# EasyEDA Pro project Athena.eprj, board PCB (continued)
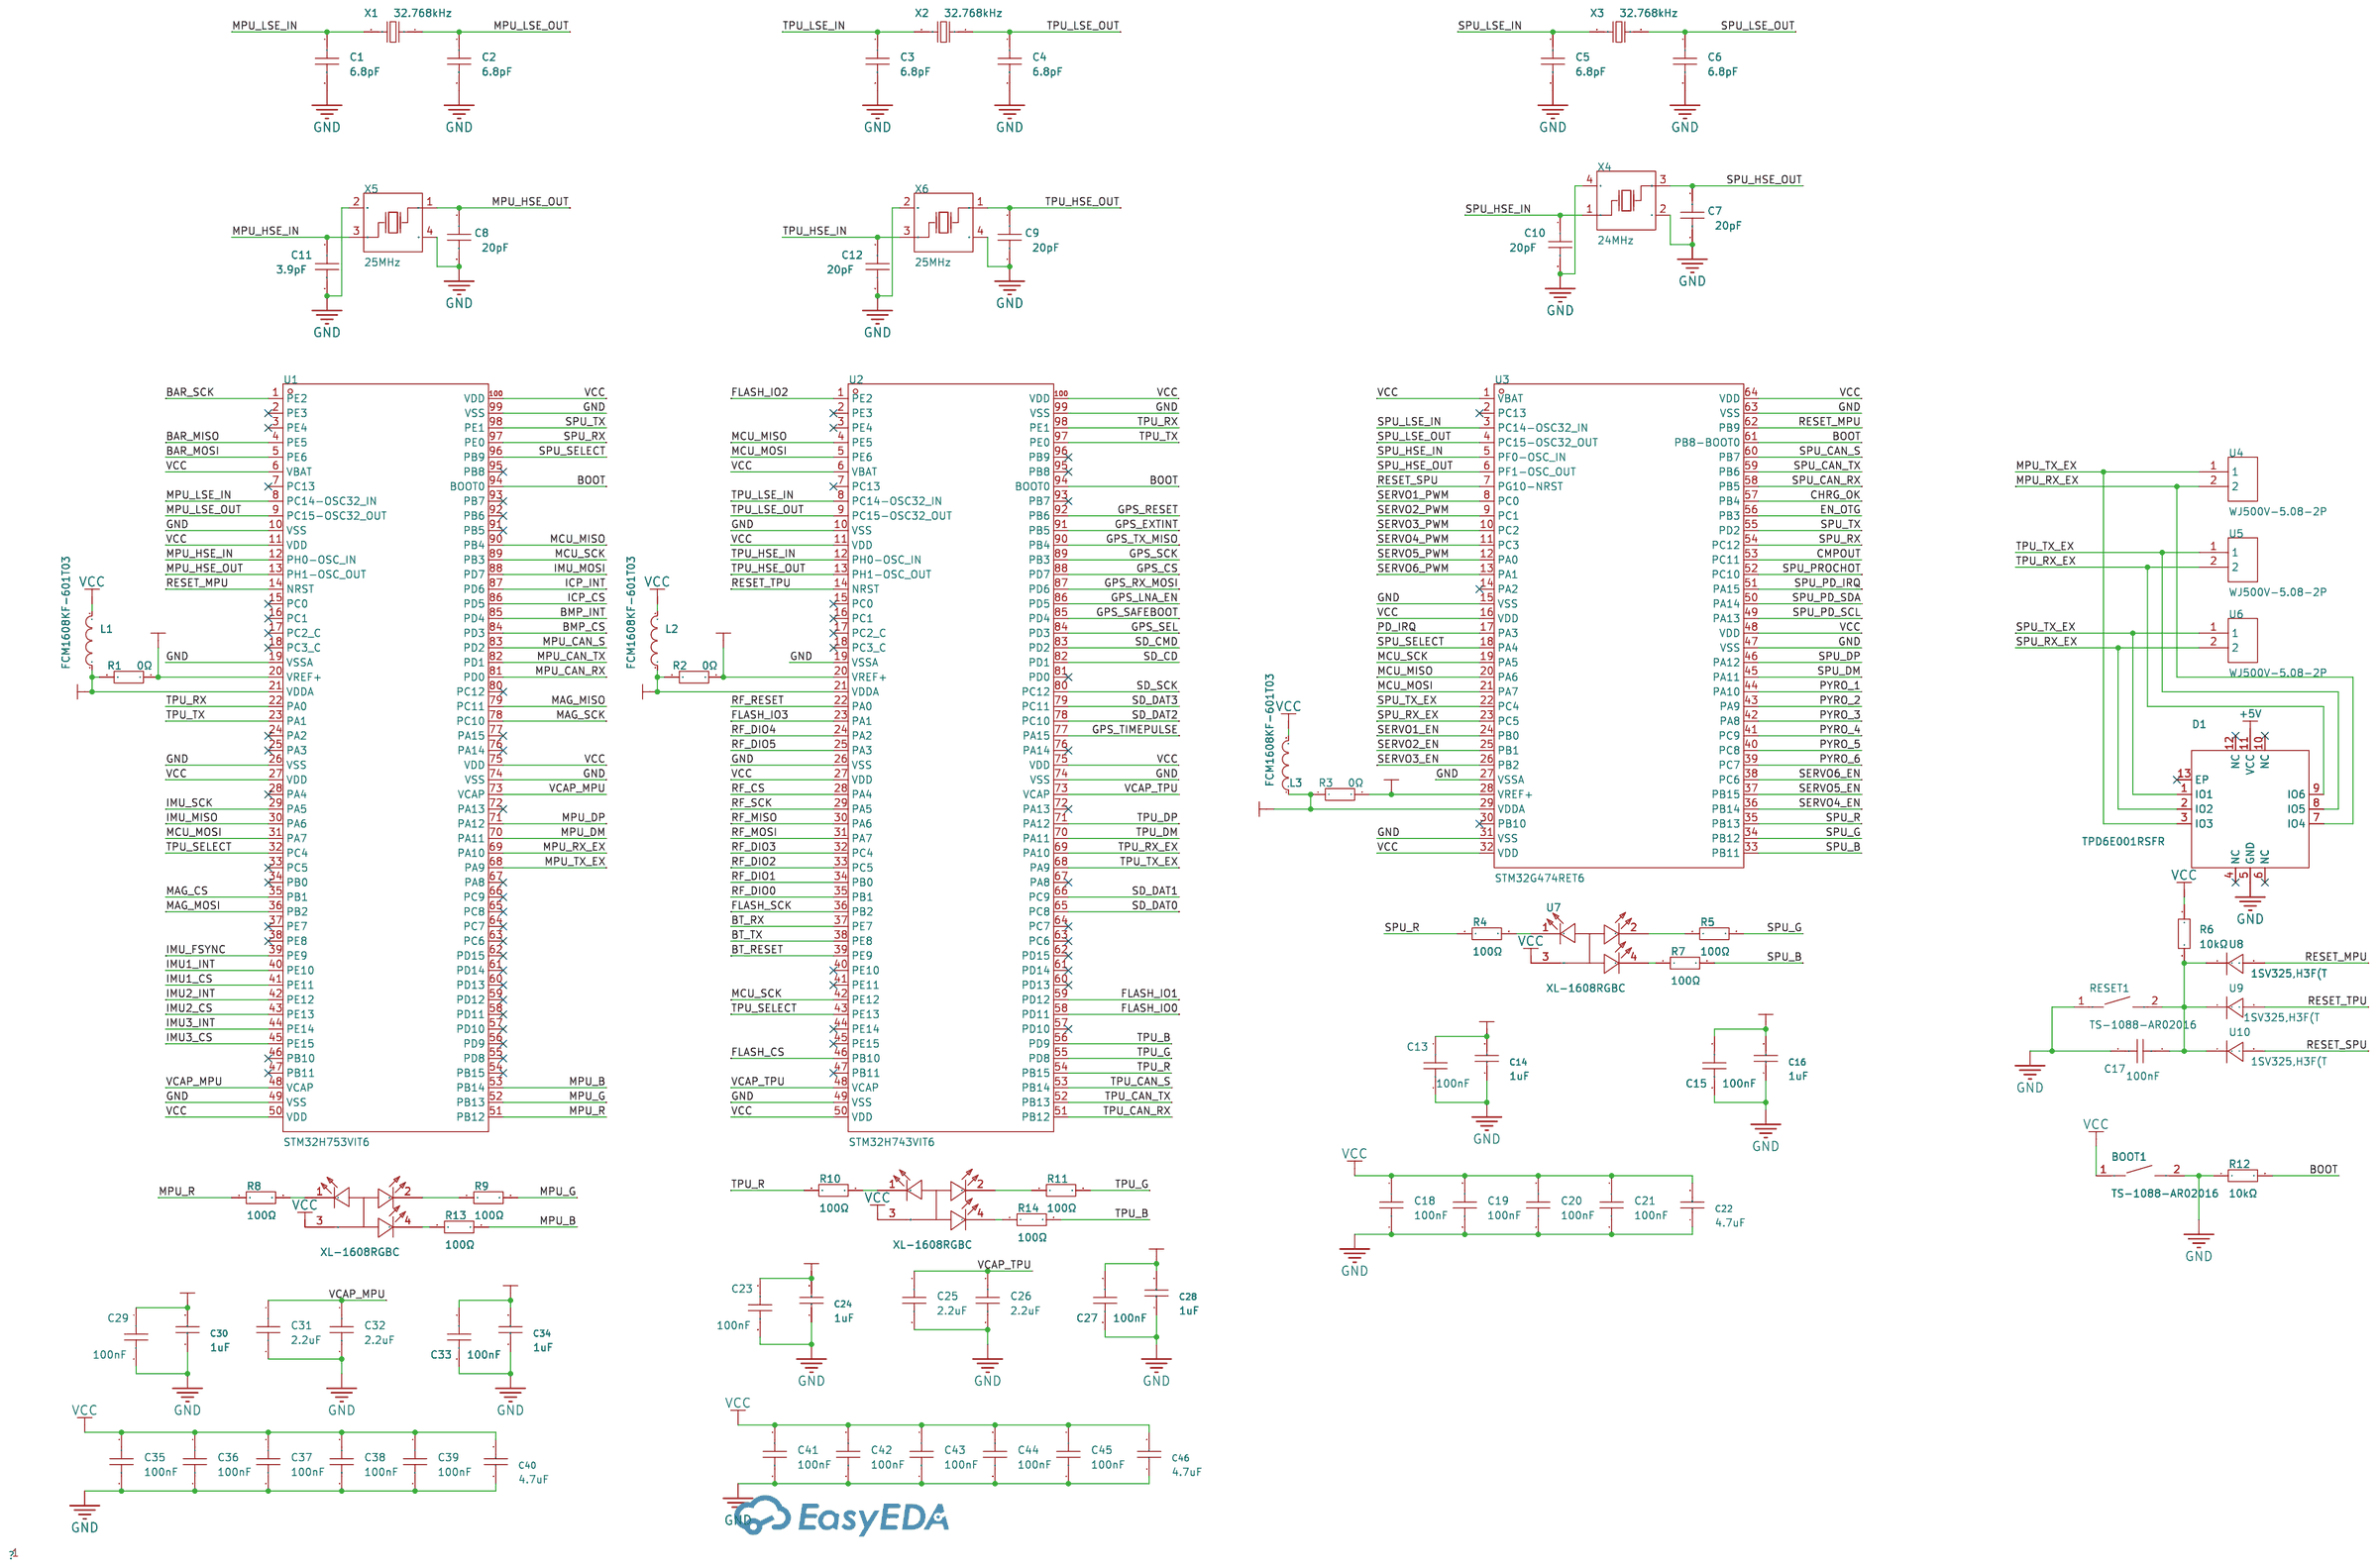
[diagram p0: Processors]
## Routing (per net, layer and track width the routed paths; a pad name or vN(x,y) marks a point on that pad's centre or on a via; arc(x,y) is an arc through that point) (continued)
$3N12479: length 8.2
  Top Layer w0.2: PYRO3.2 68.37,37.4 v1(67.7,37.4)
  Bottom Layer w0.2: 72.47,39.61 71.46,38.6 68.9,38.6 v1(67.7,37.4)
  Bottom Layer w0.4: P3.1 74.16,39.61 72.47,39.61
$3N12483: length 3
  Bottom Layer w0.4: P3.2 75.61,35.86 F3.1
$3N12487: length 1.6
  Bottom Layer w0.4: Q20.1 70.65,39.7 70.65,41.21
$3N13186: length 2.5
  Top Layer w0.2: v1(68.9,61) 68.37,61 PYRO4.1
  Bottom Layer w0.2: v1(68.9,61) 69.11,60.79 R81.2
$3N13188: length 2.9
  Bottom Layer w0.4: R69.2 R81.1 71.56,62.25 71.53,62.29
$3N13191: length 6.8
  Top Layer w0.2: PYRO4.2 68.35,62.1 v1(68.9,62.1)
  Bottom Layer w0.2: 72.48,64.29 71.49,63.3 70.1,63.3 v1(68.9,62.1)
  Bottom Layer w0.4: P4.1 74.19,64.29 72.48,64.29
$3N13195: length 3
  Bottom Layer w0.4: F4.1 75.43,60.44 P4.2
$3N13199: length 1.6
  Bottom Layer w0.4: R75.2 70.59,64.3 70.58,64.29
$3N13207: length 2.4
  Top Layer w0.2: PYRO5.1 68.31,72.2 v1(68.9,72.2)
  Bottom Layer w0.2: v1(68.9,72.2) 70.22,72.2 R82.2
$3N13209: length 2.9
  Bottom Layer w0.4: R70.2 71.49,70.52 71.49,73.36
$3N13212: length 6.7
  Top Layer w0.2: PYRO5.2 68.3,73.3 v1(68.9,73.3)
  Bottom Layer w0.2: v1(68.9,73.3) 69.93,74.33 71.22,74.33 72.24,75.36 72.44,75.36
  Bottom Layer w0.4: P5.1 74.14,75.36 72.44,75.36
$3N13216: length 3
  Bottom Layer w0.4: F5.1 75.49,71.63 P5.2
$3N13220: length 1.6
  Bottom Layer w0.4: R76.2 70.56,75.37 70.54,75.36
$3N13228: length 2.6
  Top Layer w0.2: v1(68.8,83.2) 68.23,83.2 PYRO6.1
  Bottom Layer w0.2: R83.2 70.43,83.2 v1(68.8,83.2)
$3N13230: length 2.7
  Bottom Layer w0.4: 71.5,84.3 71.5,83.03 R83.1 R71.2
$3N13233: length 7
  Top Layer w0.2: v1(68.8,84.3) 68.2,84.3 PYRO6.2
  Bottom Layer w0.2: v1(68.8,84.3) 70,85.5 71.48,85.5 72.5,86.51
  Bottom Layer w0.4: 72.5,86.51 74.19,86.51 P6.1
$3N13237: length 2.5
  Bottom Layer w0.4: 74.22,83.92 P6.2
$3N13241: length 1.7
  Bottom Layer w0.4: R77.2 70.61,86.56 Q23.1
$3N23254: length 2.8
  Top Layer w0.2: 7.84,49.49 6.62,49.49 C124.1 6.34,49.46 R105.2
$3N39600: length 5.6
  Top Layer w0.4: S1.2 24.1,5.5 24.1,7.34 24.9,8.14 Q12.3
$3N39720: length 5.8
  Top Layer w0.4: Q13.3 28.2,8.49 29.36,7.34 29.36,5.5 S2.2
$3N39836: length 5.6
  Top Layer w0.4: Q14.3 31.5,8.05 32.21,7.34 32.21,5.5 S3.2
$3N39952: length 5.5
  Top Layer w0.4: S4.2 47.46,5.5 47.46,7.34 48.2,8.08 Q15.3
$3N40068: length 5.7
  Top Layer w0.4: S5.2 52.72,5.5 52.72,7.34 51.52,8.54 51.52,8.98 Q16.3
$3N40184: length 5.5
  Top Layer w0.4: S6.2 55.57,5.5 55.57,7.34 54.8,8.11 Q17.3
$4N1461: length 1.4
  Bottom Layer w0.2: C137.1 41.2,82.45 U28.5

## Copper pours and planes (outline as drawn; the poured copper is in the pictures)
+5V on Top Layer: 47.4,37 47.4,39.1 47.7,39.4 53.3,39.4 53.9,38.8 53.9,36.96 47.44,36.96
+5V on Top Layer: 11.3,17.4 11.3,11.86 12.74,10.42 31.82,10.42 32.4,11 32.4,15.8 27.22,20.99 20.85,20.99 17.38,17.51 11.41,17.51
+5V on Bottom Layer: 55.74,37.46 55.84,37.36 55.84,36.9 59.1,36.9 59.3,36.7 59.9,36.7 60,36.8 60,37.4 59.3,37.4 58.84,37.86 57.94,37.86 57.8,38 55.74,38
+5V on POWER: 17.28,17.53 20.95,21.2 34.8,21.2 35.4,21.8 35.4,33.9 40.2,38.7 57.05,38.7 57.89,37.86 58,37.86 58,36.9 45.1,36.9 39.7,31.5 39.7,12.8 37.2,10.3 12.7,10.3 11.2,11.8 11.2,17.53
+5V on POWER: 17.6,12.2 21.65,12.2 21.65,4.45 17.6,4.45
AGND on Bottom Layer: 4.8,27.2 7.8,27.2 10.9,30.3 10.9,46 7.55,49.35 7.55,51.5 8.05,52 21.35,52 21.4,52.05 21.4,53.95 19.6,55.75 5.75,55.75 3.6,53.6 3.6,47.65 7.95,43.3 7.95,32.1 6.75,30.9 4.35,30.9 3.85,30.4 3.85,28.15
AGND on Bottom Layer: 45.4,55.3 69.61,55.3 69.61,51.57 45.4,51.57
AGND on Bottom Layer: 42.42,55.08 42.7,54.8 42.7,52.9 45.4,52.9 45.4,60.2 30.2,60.2 26.9,56.9 18,56.9 16.6,55.5 8,55.5 8,52.29 8.24,52.06 23.36,52.06 23.5,52.2 23.5,54 21.08,54 21.08,55.08
GND on Top Layer: 0,140 80,140 80,0 0,0
GND on Bottom Layer: 0,140 80,140 80,0 0,0
GND on GND: 0,140 80,140 80,0 0,0
GND on SIGNAL: 0,140 80,140 80,0 0,0
GND on GND2: 0,140 80,140 80,0 0,0
VBUS on Top Layer: 61.03,31.23 61.5,31.7 61.5,32.4 61.4,32.5 59.1,32.5 57.8,31.2 57.8,29.1 58,28.9 60.8,28.9 61,29.1 61,31.23
VBUS on Bottom Layer: 53.59,35.9 53.59,33.7 46.8,33.7 46.8,35.9
VBUS on Bottom Layer: 61.5,33.6 60.2,33.6 59.8,33.2 59.8,32.31 59.44,31.96 60.2,31.2 61,31.2 61.5,31.7
VBUS on Bottom Layer: 60.1,35.4 60.1,36.66 56.66,36.66 56.3,36.3 56.3,35.6 56.1,35.4
VBUS on POWER: 42.9,4.47 42.9,31 45.6,33.7 57.7,33.7 60.2,31.2 61,31.2 61.5,31.7 61.5,34.9 59.7,36.7 45.2,36.7 39.9,31.4 39.9,12.6 37.1,9.8 37.1,4.47
VCC on Bottom Layer: 17.8,58.7 22.3,58.7 24.6,61 24.6,64.94 22.6,66.94 20.8,66.94 20.59,66.73 20.59,63.43 19.66,62.5 19.66,60.77 18.85,59.95 17.8,59.95 17.2,59.35 17.8,58.75
VCC on POWER: 0,140 80,140 80,0 0,0
BAT on Bottom Layer: 4.2,21.9 10.55,21.9 19,30.35 19,35.35 20.75,37.1 20.75,38.7 20.55,38.9 18.25,38.9 18.2,38.85 18.2,39.57 17.97,39.8 14.6,39.8 14.1,39.3 14.1,33.5 15.15,32.45 15.15,30 10.85,25.7 4.7,25.7 3.85,24.85 3.85,22.25
PPHV on Top Layer: 61.1,31.1 61.1,27.9 61.3,27.7 66,27.7 66.5,28.2 66.5,30.8 66.1,31.2 61.2,31.2
PPHV on Bottom Layer: 68.9,47.73 68.9,48.1 69.75,48.95 69.75,50.95 69.2,51.5 52.22,51.5 51.6,50.88 51.6,49.5 52.3,48.8 53.8,48.8 54.51,49.51 55.39,49.51 55.9,49 55.9,48.2 56.35,47.75 56.35,47.73
PPHV on Bottom Layer: 61.51,33.6 61.51,32.79 61.6,32.7 61.6,31.6 61.1,31.1 61.1,29.8 65.7,29.8 66,30.1 66,30.9 65.8,31.1 62.8,31.1 62.8,33.6
PPHV on POWER: 61.3,29.8 61.3,31.1 64.9,31.1 65.1,31.3 65.1,47.6 65,47.7 56.2,47.7 55.7,48.2 55.7,50.71 56.14,51.15 69.25,51.15 69.6,50.8 69.6,48.4 68.9,47.7 68.9,30.6 68.1,29.8
VSYS on Top Layer: 11.39,32.6 19.6,32.6 19.95,32.25 19.95,30.55 19.5,30.1 11.5,30.1 11.2,30.4 11.2,32.38
VSYS on Bottom Layer: 16.25,55.95 16.25,59.4 16.15,59.5 9.45,59.5 8.1,58.15 8.1,56.1 8.25,55.95
VSYS on Bottom Layer: 8,51.9 22.3,51.9 24,50.2 27.3,50.2 27.3,44.1 25.6,42.4 22,42.4 21.2,43.2 21.2,48.7 8.83,48.7 8,49.53
VSYS on Bottom Layer: 21.31,49.99 21.5,49.8 21.5,49 21.3,48.8 13.9,48.8 13.9,33.4 14.8,32.5 14.8,30 11.1,30 11.1,46 10.4,46.7 10.4,47 9.19,48.22 9.19,49.99
VSYS on POWER: 8.05,51.75 8.14,51.66 8.14,49.49 8.82,48.8 21.15,48.8 21.4,49.05 21.4,58.1 21.05,58.45 8.1,58.45 8.1,51.8
$2N9095 on Bottom Layer: 40.2,49.8 40.2,46.9 40.8,46.3 45.6,46.3 46.7,47.4 50.9,47.4 51.3,47.8 51.3,51.2 51,51.5 44.9,51.5 43.2,49.8
$2N10669 on Bottom Layer: 33.8,54.9 42.4,54.9 42.4,50 33.8,50
$2N10669 on Bottom Layer: 39.55,51.05 38.9,50.4 37.5,50.4 37.5,47.7 34.5,44.7 34.5,44 34.6,43.9 36.79,43.9 37.59,44.7 39.9,44.7 39.9,49.7 40.4,50.2
$2N10868 on Bottom Layer: 27.63,52.21 27.63,43.87 27.9,43.6 29.7,43.6 30.2,43.1 31.6,43.1 31.6,43.3 31.4,43.5 30.4,43.5 29.7,44.2 29.7,46.52 32.06,48.88 32.06,52.78 28.19,52.78
$2N10868 on Bottom Layer: 23.7,54.9 23.7,50.62 24.21,50.1 26.3,50.1 26.3,51.6 26.82,52.12 32.99,52.12 33.19,52.32 33.19,54.71 33,54.9
$2N11948 on Bottom Layer: 24.9,40 24.6,39.7 22.2,39.7 21.9,40 20.8,40 20.8,39.2 20.5,38.9 18.49,38.9 18.28,39.11 18.28,39.72 17.9,40.1 15.99,40.1 15.34,40.75 15.34,42.34 15.5,42.5 18.7,42.5 18.9,42.3 24.9,42.3
$2N34654 on Top Layer: 20.2,30.13 20.2,38.63 20.57,39 20.57,39 22.9,39 23.1,38.8 23.1,31.06 22.16,30.11 20.21,30.11
$2N35129 on Top Layer: 23.09,25.9 23.09,30.69 23.4,31 23.4,34.96 24.27,34.96 24.99,36.3 29.65,36.3 30.22,35.74 30.22,27.22 28.9,25.9
$3N11988 on POWER: 63.19,3.9 70.3,3.9 73.1,6.7 73.1,87.5 70,90.6 69.03,90.6 69.03,56.57 69.8,55.8 69.8,48.2 69.03,47.43 69.03,12.03 66.19,9.19 63.19,9.19
$3N11988 on POWER: 71,31.93 75.16,31.93 73.84,33.25 72.32,33.25

## Text on the board
Top Silkscreen Layer: 5V | 3V3 | BAT | CAN | MPU UART | SPU UART | TPU UART | TPU STATUS | LoRa | IMU 3 | TPU | MPU STATUS | FLASH | MAG | MPU | IMU 1 | SPU | IMU 2 | ARM | SPU STATUS | GPS | PYRO 1 | PYRO 6 | PYRO 5 | PYRO 4 | PYRO 3 | PYRO 2 | + | -
